# EasyEDA Pro project ProProject_IMUSensorNodes202312.epro, board 6_6_拼板20240123（带编号） (continued)
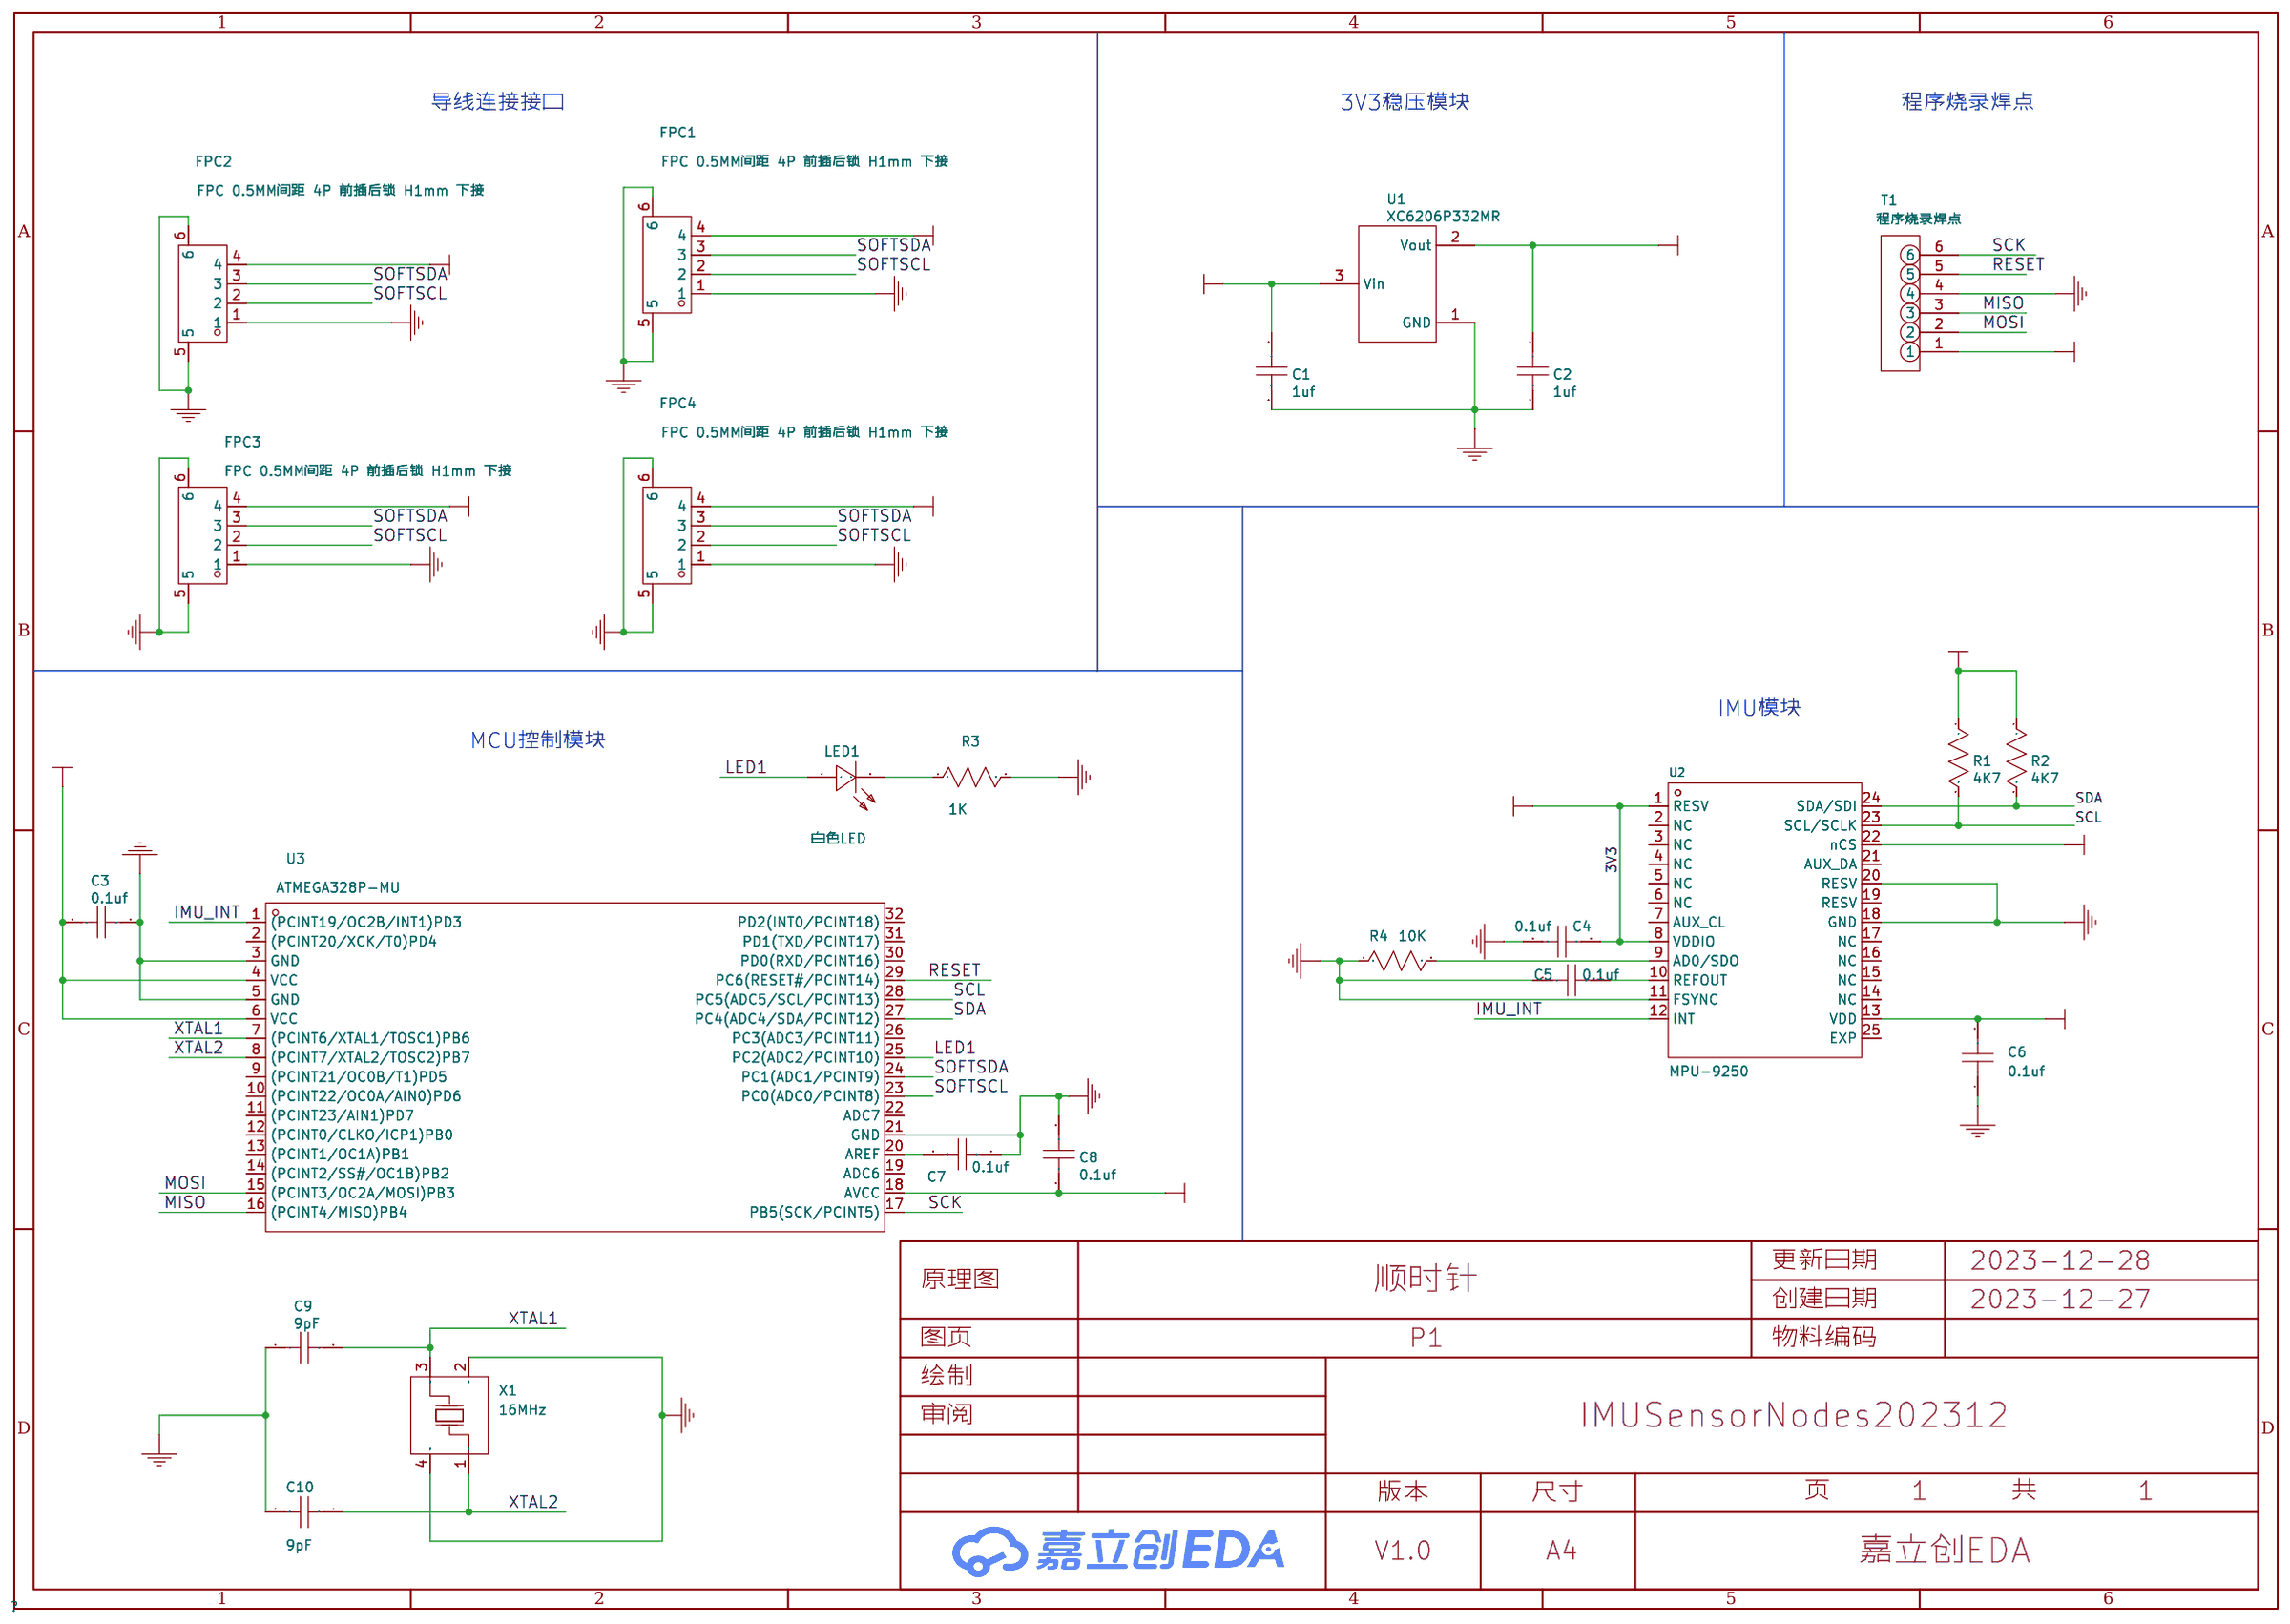
[diagram p0: schematic sheet]
## Routing (per net, layer and track width the routed paths; a pad name or vN(x,y) marks a point on that pad's centre or on a via; arc(x,y) is an arc through that point) (continued)
  Bottom Layer w0.15: Designator#773.2 49.46,52.23 50.45,52.23 50.98,51.7 v1(50.98,51.57) ; Designator#604.2 49.46,11.08 50.45,11.08 50.98,10.55 v1(50.98,10.42) ; v1(78.28,65.28) 78.28,65.42 77.75,65.94 76.76,65.94 Designator#733.2 ; v1(50.98,24.13) 50.98,24.27 50.45,24.79 49.46,24.79 Designator#551.2 ; Designator#510.2 76.76,79.66 77.75,79.66 78.28,79.13 v1(78.28,79) ; Designator#793.2 76.76,52.23 77.75,52.23 78.28,51.7 v1(78.28,51.57) ; v1(23.67,10.42) 23.67,10.55 23.15,11.08 22.15,11.08 Designator#584.2 ; v1(50.98,79) 50.98,79.13 50.45,79.66 49.46,79.66 Designator#673.2 ; Designator#651.2 22.15,79.66 23.15,79.66 23.67,79.13 v1(23.67,79) ; Designator#713.2 49.46,65.94 50.45,65.94 50.98,65.42 v1(50.98,65.28) ; v1(50.98,37.85) 50.98,37.98 50.45,38.51 49.46,38.51 Designator#480.2 ; Designator#693.2 22.15,65.94 23.15,65.94 23.67,65.42 v1(23.67,65.28) ; v1(78.28,37.85) 78.28,37.98 77.75,38.51 76.76,38.51 Designator#500.2 ; v1(23.67,51.57) 23.67,51.7 23.15,52.23 22.15,52.23 Designator#753.2 ; Designator#624.2 76.76,11.08 77.75,11.08 78.28,10.55 v1(78.28,10.42) ; Designator#530.2 22.15,24.79 23.15,24.79 23.67,24.27 v1(23.67,24.13) ; v1(78.28,24.13) 78.28,24.27 77.75,24.79 76.76,24.79 Designator#445.2 ; v1(23.67,37.85) 23.67,37.98 23.15,38.51 22.15,38.51 Designator#460.2
  Bottom Layer w0.152: Designator#896.5 59.21,61.75 58.6,62.36 58.48,62.36 58.45,62.39 58.36,62.39 58.21,62.53 Designator#819.18 ; Designator#888.18 3.6,48.82 3.75,48.67 3.84,48.67 3.87,48.64 3.99,48.64 4.6,48.03 Designator#803.5 ; Designator#917.5 4.6,6.89 3.99,7.5 3.87,7.5 3.84,7.52 3.75,7.52 3.6,7.67 Designator#438.18 ; Designator#901.18 30.91,76.25 31.06,76.1 31.15,76.1 31.17,76.08 31.29,76.08 31.9,75.47 Designator#313.5 ; Designator#319.18 30.91,48.82 31.06,48.67 31.15,48.67 31.17,48.64 31.29,48.64 31.9,48.03 Designator#916.5 ; Designator#877.18 58.21,48.82 58.36,48.67 58.45,48.67 58.48,48.64 58.6,48.64 59.21,48.03 Designator#920.5 ; Designator#806.5 31.9,6.89 31.29,7.5 31.17,7.5 31.15,7.52 31.06,7.52 30.91,7.67 Designator#831.18 ; Designator#832.5 59.21,6.89 58.6,7.5 58.48,7.5 58.45,7.52 58.36,7.52 58.21,7.67 Designator#911.18 ; Designator#437.18 3.6,76.25 3.75,76.1 3.84,76.1 3.87,76.08 3.99,76.08 4.6,75.47 Designator#325.5 ; Designator#903.5 59.21,75.47 58.6,76.08 58.48,76.08 58.45,76.1 58.36,76.1 58.21,76.25 Designator#814.18 ; Designator#317.18 3.6,35.1 3.75,34.95 3.84,34.95 3.87,34.93 3.99,34.93 4.6,34.32 Designator#440.5 ; Designator#321.5 31.9,20.6 31.29,21.21 31.17,21.21 31.15,21.24 31.06,21.24 30.91,21.39 Designator#909.18 ; Designator#811.5 4.6,61.75 3.99,62.36 3.87,62.36 3.84,62.39 3.75,62.39 3.6,62.53 Designator#818.18 ; Designator#829.5 59.21,20.6 58.6,21.21 58.48,21.21 58.45,21.24 58.36,21.24 58.21,21.39 Designator#900.18 ; Designator#878.18 30.91,62.53 31.06,62.39 31.15,62.39 31.17,62.36 31.29,62.36 31.9,61.75 Designator#808.5 ; Designator#892.5 59.21,34.32 58.6,34.93 58.48,34.93 58.45,34.95 58.36,34.95 58.21,35.1 Designator#919.18 ; Designator#827.5 31.9,34.32 31.29,34.93 31.17,34.93 31.15,34.95 31.06,34.95 30.91,35.1 Designator#921.18 ; Designator#318.18 3.6,21.39 3.75,21.24 3.84,21.24 3.87,21.21 3.99,21.21 4.6,20.6 Designator#837.5
  Bottom Layer w0.2: Designator#314.18 44.62,63.16 45.62,64.16 Designator#314.25 46.22,63.69 Designator#314.11 47.84,63.69 v1(48.04,63.5) 48.57,64.03 Designator#714.1 Designator#408.1 ; Designator#878.11 33.37,63.66 34.73,63.66 34.98,63.91 Designator#704.1 Designator#405.1 ; 17.32,62.86 17.32,63.16 18.32,64.16 Designator#915.25 18.92,63.69 Designator#915.11 20.54,63.69 v1(20.73,63.5) 21.27,64.03 Designator#694.1 Designator#402.1 ; Designator#819.11 60.68,63.66 62.04,63.66 62.29,63.91 Designator#724.1 Designator#411.1 ; Designator#435.1 Designator#451.1 7.68,36.47 7.43,36.22 6.07,36.22 Designator#317.11 ; Designator#396.1 Designator#674.1 48.57,77.74 v1(48.04,77.21) 47.84,77.41 46.22,77.41 Designator#880.25 45.62,77.88 44.62,76.88 Designator#880.18 ; Designator#921.11 33.37,36.22 34.73,36.22 34.98,36.47 Designator#471.1 Designator#334.1 ; Designator#906.21 v1(72.42,43.53) 72.42,44.86 Designator#906.33 ; Designator#378.1 Designator#615.1 62.29,9.04 62.04,8.79 60.68,8.79 Designator#911.11 ; Designator#897.18 44.62,49.45 45.62,50.45 Designator#897.25 46.22,49.97 47.84,49.97 v1(48.04,49.78) 48.57,50.31 Designator#774.1 Designator#426.1 ; 6.03,77.41 6.07,77.37 7.43,77.37 7.68,77.62 Designator#635.1 Designator#384.1 ; Designator#882.18 44.62,35.73 45.62,36.73 Designator#882.25 46.22,36.26 Designator#882.11 47.84,36.26 v1(48.04,36.06) 48.57,36.59 Designator#481.1 Designator#337.1 ; Designator#432.1 Designator#794.1 75.88,50.31 v1(75.34,49.78) 75.15,49.97 73.53,49.97 Designator#912.25 72.93,50.45 71.93,49.45 Designator#912.18 ; Designator#328.1 Designator#446.1 75.88,22.88 v1(75.34,22.35) 75.15,22.54 Designator#883.11 73.53,22.54 Designator#883.25 72.93,23.02 71.93,22.02 Designator#883.18 ; Designator#909.11 33.37,22.51 34.73,22.51 34.98,22.76 Designator#541.1 Designator#355.1 ; 17.32,21.72 17.32,22.02 18.32,23.02 Designator#836.25 18.92,22.54 Designator#836.11 20.54,22.54 v1(20.73,22.35) 21.27,22.88 Designator#531.1 Designator#352.1 ; Designator#331.1 Designator#461.1 21.27,36.59 v1(20.73,36.06) 20.54,36.26 Designator#923.11 18.92,36.26 Designator#923.25 18.32,36.73 17.32,35.73 17.32,35.43 ; Designator#889.33 45.12,72.3 v1(45.12,70.96) Designator#889.21 ; Designator#818.11 6.07,63.66 7.43,63.66 7.68,63.91 Designator#684.1 Designator#399.1 ; Designator#318.11 6.07,22.51 7.43,22.51 7.68,22.76 Designator#521.1 Designator#349.1 ; Designator#820.21 v1(17.81,70.96) 17.81,72.3 Designator#820.33 ; Designator#839.21 v1(45.12,29.81) 45.12,31.15 Designator#839.33 ; Designator#372.1 Designator#595.1 34.98,9.04 34.73,8.79 33.37,8.79 Designator#831.11 ; Designator#895.33 72.42,17.43 v1(72.42,16.1) Designator#895.21 ; 17.32,76.58 17.32,76.88 18.32,77.88 Designator#886.25 18.92,77.41 20.54,77.41 v1(20.73,77.21) 21.27,77.74 Designator#652.1 Designator#390.1 ; Designator#801.33 72.42,31.15 v1(72.42,29.81) Designator#801.21 ; 6.03,49.97 6.07,49.94 7.43,49.94 7.68,50.19 Designator#744.1 Designator#417.1 ; Designator#913.33 17.81,3.72 v1(17.81,2.38) Designator#913.21 ; Designator#904.21 v1(17.81,16.1) 17.81,17.43 Designator#904.33 ; 33.34,77.41 33.37,77.37 34.73,77.37 34.98,77.62 Designator#664.1 Designator#393.1 ; 33.34,49.97 33.37,49.94 34.73,49.94 34.98,50.19 Designator#764.1 Designator#423.1 ; Designator#322.33 45.12,44.86 v1(45.12,43.53) Designator#322.21 ; Designator#810.33 72.42,72.3 v1(72.42,70.96) Designator#810.21 ; Designator#813.18 44.62,22.02 45.62,23.02 Designator#813.25 46.22,22.54 Designator#813.11 47.84,22.54 v1(48.04,22.35) 48.57,22.88 Designator#552.1 Designator#358.1 ; Designator#340.1 Designator#491.1 62.29,36.47 62.04,36.22 60.68,36.22 Designator#919.11 ; Designator#809.33 72.42,58.58 v1(72.42,57.25) Designator#809.21 ; Designator#346.1 Designator#511.1 75.88,77.74 v1(75.34,77.21) 75.15,77.41 73.53,77.41 Designator#918.25 72.93,77.88 71.93,76.88 Designator#918.18 ; Designator#324.33 45.12,58.58 v1(45.12,57.25) Designator#324.21 ; Designator#429.1 Designator#784.1 62.29,50.19 62.04,49.94 60.68,49.94 60.64,49.97 ; Designator#438.11 6.07,8.79 7.43,8.79 7.68,9.04 Designator#575.1 Designator#366.1 ; Designator#902.33 17.81,44.86 v1(17.81,43.53) Designator#902.21 ; Designator#361.1 Designator#560.1 62.29,22.76 62.04,22.51 60.68,22.51 Designator#900.11 ; Designator#375.1 Designator#605.1 48.57,9.16 v1(48.04,8.63) 47.84,8.83 Designator#326.11 46.22,8.83 Designator#326.25 45.62,9.3 44.62,8.3 Designator#326.18 ; 17.32,49.15 17.32,49.45 18.32,50.45 Designator#890.25 18.92,49.97 20.54,49.97 v1(20.73,49.78) 21.27,50.31 Designator#754.1 Designator#420.1 ; Designator#835.33 17.81,58.58 v1(17.81,57.25) Designator#835.21 ; Designator#343.1 Designator#501.1 75.88,36.59 v1(75.34,36.06) 75.15,36.26 Designator#830.11 73.53,36.26 Designator#830.25 72.93,36.73 71.93,35.73 Designator#830.18 ; Designator#826.18 71.93,8.3 72.93,9.3 Designator#826.25 73.53,8.83 Designator#826.11 75.15,8.83 v1(75.34,8.63) 75.88,9.16 Designator#625.1 Designator#381.1 ; Designator#369.1 Designator#585.1 21.27,9.16 v1(20.73,8.63) 20.54,8.83 Designator#323.11 18.92,8.83 Designator#323.25 18.32,9.3 17.32,8.3 17.32,8 ; Designator#881.18 71.93,63.16 72.93,64.16 Designator#881.25 73.53,63.69 Designator#881.11 75.15,63.69 v1(75.34,63.5) 75.88,64.03 Designator#734.1 Designator#414.1 ; Designator#838.33 45.12,3.72 v1(45.12,2.38) Designator#838.21 ; Designator#822.21 v1(17.81,29.81) 17.81,31.15 Designator#822.33 ; Designator#910.33 72.42,3.72 v1(72.42,2.38) Designator#910.21 ; Designator#387.1 Designator#654.1 62.29,77.62 62.04,77.37 60.68,77.37 60.64,77.41 ; Designator#885.21 v1(45.12,16.1) 45.12,17.43 Designator#885.33
  Bottom Layer w0.254: v1(69.9,21.71) 70.01,21.71 70.24,21.49 70.24,20.98 ; Designator#476.2 48.52,31.7 v1(49.28,32.46) 49,32.46 48.52,32.95 Designator#474.2 ; Designator#600.2 48.52,4.27 v1(49.28,5.03) 49,5.03 48.52,5.52 Designator#598.2 ; Designator#525.1 17.81,14.54 Designator#904.21 ; 64.19,79.28 64.42,79.28 64.57,79.13 v2(64.57,79.02) 64.57,78.13 64.45,78.01 ; 36.88,24.41 37.12,24.41 37.27,24.26 v2(37.27,24.16) 37.27,23.27 37.14,23.14 ; Designator#549.2 50.98,23.26 v1(50.98,24.13) 50.7,24.41 Designator#550.1 ; Designator#580.2 21.21,4.27 v1(21.98,5.03) 21.7,5.03 21.21,5.52 Designator#578.2 ; Designator#822.3 17.31,32.02 v1(17.43,31.91) 17.94,31.4 Designator#822.33 18.31,31.65 Designator#822.5 ; Designator#641.2 56.42,76.84 v1(56.42,77.25) ; Designator#618.2 75.82,5.52 76.31,5.03 v1(76.59,5.03) 75.82,4.27 Designator#620.2 ; 37.14,78.01 37.27,78.13 v2(37.27,79.02) 37.27,79.13 37.12,79.28 36.88,79.28 ; Designator#691.2 23.67,64.41 v1(23.67,65.28) 23.39,65.56 Designator#692.1 ; 64.19,65.56 64.42,65.56 64.57,65.41 v2(64.57,65.31) 64.57,64.42 64.45,64.29 ; Designator#528.2 23.67,23.26 v1(23.67,24.13) 23.39,24.41 Designator#529.1 ; v1(55.53,1.55) 55.15,1.93 55.15,2.44 55.53,2.82 57.82,2.82 Designator#832.33 ; 15.63,34.7 15.63,35.21 15.4,35.43 v1(15.29,35.43) ; Designator#917.33 3.21,2.82 0.92,2.82 0.54,2.44 0.54,1.93 v1(0.92,1.55) ; Designator#324.21 45.12,55.68 Designator#708.1 ; 37.14,9.43 37.27,9.55 v2(37.27,10.44) 37.27,10.55 37.12,10.7 36.88,10.7 ; Designator#314.20 45.02,63.69 arc(45.1,63.7) 45.17,63.71 arc(45.45,63.87) 45.61,64.15 arc(45.62,64.22) Designator#314.25 ; v1(28.22,1.55) 27.84,1.93 27.84,2.44 28.22,2.82 30.51,2.82 Designator#806.33 ; Designator#499.1 78,38.13 v1(78.28,37.85) 78.28,36.98 Designator#498.2 ; Designator#829.33 57.82,16.54 55.53,16.54 55.15,16.16 55.15,15.65 v1(55.53,15.27) ; v1(79.66,19.21) Designator#562.2 ; v1(29.11,63.53) 29.11,63.12 Designator#700.2 ; 64.19,38.13 64.42,38.13 64.57,37.98 v2(64.57,37.88) 64.57,36.98 64.45,36.86 ; Designator#603.1 50.7,10.7 v1(50.98,10.42) 50.98,9.55 Designator#602.2 ; Designator#727.2 75.82,60.38 76.31,59.89 v1(76.59,59.89) 75.82,59.13 Designator#729.2 ; v1(29.11,8.66) 29.11,8.26 Designator#591.2 ; v1(42.6,35.43) 42.71,35.43 42.93,35.21 42.93,34.7 ; Designator#882.20 45.02,36.26 arc(45.1,36.26) 45.17,36.28 arc(45.45,36.44) 45.61,36.71 arc(45.62,36.79) Designator#882.25 ; 9.84,64.29 9.96,64.42 v2(9.96,65.31) 9.96,65.41 9.81,65.56 9.58,65.56 ; v1(29.11,22.38) 29.11,21.97 Designator#537.2 ; v1(1.81,8.66) 1.81,8.26 Designator#571.2 ; Designator#650.1 23.39,79.28 v1(23.67,79) 23.67,78.13 Designator#649.2 ; Designator#324.5 45.62,59.08 Designator#324.33 45.24,58.83 v1(44.73,59.34) 44.62,59.45 Designator#324.3 ; Designator#839.3 44.62,32.02 v1(44.73,31.91) 45.24,31.4 Designator#839.33 45.62,31.65 Designator#839.5 ; 42.93,7.27 42.93,7.78 42.71,8 v1(42.6,8) ; Designator#902.21 17.81,41.97 Designator#748.1 ; v1(15.29,8) 15.4,8 15.63,7.78 15.63,7.27 ; v1(56.42,8.66) 56.42,8.26 Designator#611.2 ; Designator#889.5 45.62,72.8 Designator#889.33 45.24,72.55 v1(44.73,73.05) 44.62,73.17 Designator#889.3 ; Designator#517.2 1.81,21.97 v1(1.81,22.38) ; 64.45,50.58 64.57,50.7 v2(64.57,51.59) 64.57,51.69 64.42,51.84 64.19,51.84 ; Designator#544.2 48.52,19.23 49,18.75 v1(49.28,18.75) 48.52,17.98 Designator#546.2 ; v1(55.53,56.42) 55.15,56.8 55.15,57.31 55.53,57.69 57.82,57.69 Designator#896.33 ; Designator#769.2 48.52,45.41 v1(49.28,46.18) 49,46.18 48.52,46.66 Designator#767.2 ; Designator#885.21 45.12,14.54 Designator#545.1 ; Designator#895.21 72.42,14.54 Designator#564.1 ; Designator#904.5 18.31,17.93 Designator#904.33 17.94,17.68 v1(17.43,18.19) 17.31,18.31 Designator#904.3 ; Designator#313.33 30.51,71.4 28.22,71.4 27.84,71.02 27.84,70.51 v1(28.22,70.13) ; v1(56.42,63.53) 56.42,63.12 Designator#720.2 ; v1(69.9,62.86) 70.01,62.86 70.24,62.64 70.24,62.13 ; 42.93,75.85 42.93,76.36 42.71,76.58 v1(42.6,76.58) ; Designator#913.5 18.31,4.22 Designator#913.33 17.94,3.97 v1(17.43,4.47) 17.31,4.59 Designator#913.3 ; 15.63,20.98 15.63,21.49 15.4,21.71 v1(15.29,21.71) ; 37.14,36.86 37.27,36.98 v2(37.27,37.88) 37.27,37.98 37.12,38.13 36.88,38.13 ; v1(79.66,46.64) Designator#786.2 ; Designator#731.2 78.28,64.41 v1(78.28,65.28) 78,65.56 Designator#732.1 ; v1(42.6,49.15) 42.71,49.15 42.93,48.92 42.93,48.42 ; 9.58,79.28 9.81,79.28 9.96,79.13 v2(9.96,79.02) 9.96,78.13 9.84,78.01 ; Designator#444.1 78,24.41 v1(78.28,24.13) 78.28,23.26 Designator#443.2 ; Designator#810.21 72.42,69.4 Designator#505.1 ; v1(52.35,5.49) Designator#597.2 ; Designator#820.5 18.31,72.8 Designator#820.33 17.94,72.55 v1(17.43,73.05) 17.31,73.17 Designator#820.3 ; Designator#889.21 45.12,69.4 Designator#668.1 ; Designator#801.21 72.42,28.25 Designator#495.1 ; Designator#711.2 50.98,64.41 v1(50.98,65.28) 50.7,65.56 Designator#712.1 ; Designator#813.20 45.02,22.54 arc(45.1,22.55) 45.17,22.56 arc(45.45,22.72) 45.61,23 arc(45.62,23.07) Designator#813.25 ; Designator#809.5 72.92,59.08 Designator#809.33 72.55,58.83 v1(72.04,59.34) 71.92,59.45 Designator#809.3 ; Designator#810.5 72.92,72.8 Designator#810.33 72.55,72.55 v1(72.04,73.05) 71.92,73.17 Designator#810.3 ; Designator#809.21 72.42,55.68 Designator#728.1 ; 36.88,65.56 37.12,65.56 37.27,65.41 v2(37.27,65.31) 37.27,64.42 37.14,64.29 ; Designator#791.2 78.28,50.7 v1(78.28,51.57) 78,51.84 Designator#792.1 ; Designator#895.5 72.92,17.93 Designator#895.33 72.55,17.68 v1(72.04,18.19) 71.92,18.31 Designator#895.3 ; Designator#526.2 21.21,17.98 v1(21.98,18.75) 21.7,18.75 21.21,19.23 Designator#524.2 ; Designator#910.21 72.42,0.82 Designator#619.1 ; Designator#660.2 29.11,76.84 v1(29.11,77.25) ; v1(28.22,15.27) 27.84,15.65 27.84,16.16 28.22,16.54 30.51,16.54 Designator#321.33 ; 15.63,48.42 15.63,48.92 15.4,49.15 v1(15.29,49.15) ; Designator#454.2 21.21,32.95 21.7,32.46 v1(21.98,32.46) 21.21,31.7 Designator#456.2 ; Designator#789.2 75.82,45.41 v1(76.59,46.18) 76.31,46.18 75.82,46.66 Designator#787.2 ; v1(79.66,60.35) Designator#726.2 ; 71.5,49.97 72.33,49.97 arc(72.4,49.98) 72.47,49.99 arc(72.75,50.15) 72.91,50.43 arc(72.92,50.5) Designator#912.25 ; v1(79.66,32.92) Designator#493.2 ; Designator#838.3 44.62,4.59 v1(44.73,4.47) 45.24,3.97 Designator#838.33 45.62,4.22 Designator#838.5 ; Designator#910.5 72.92,4.22 Designator#910.33 72.55,3.97 v1(72.04,4.47) 71.92,4.59 Designator#910.3 ; v1(28.22,42.7) 27.84,43.08 27.84,43.59 28.22,43.97 30.51,43.97 Designator#916.33 ; 9.84,50.58 9.96,50.7 v2(9.96,51.59) 9.96,51.69 9.81,51.84 9.58,51.84 ; 70.24,7.27 70.24,7.78 70.01,8 v1(69.9,8) ; Designator#883.20 72.33,22.54 arc(72.4,22.55) 72.47,22.56 arc(72.75,22.72) 72.91,23 arc(72.92,23.07) Designator#883.25 ; Designator#487.2 56.42,35.69 v1(56.42,36.1) ; Designator#751.2 23.67,50.7 v1(23.67,51.57) 23.39,51.84 Designator#752.1 ; Designator#583.1 23.39,10.7 v1(23.67,10.42) 23.67,9.55 Designator#582.2 ; Designator#459.1 23.39,38.13 v1(23.67,37.85) 23.67,36.98 Designator#458.2 ; Designator#801.5 72.92,31.65 Designator#801.33 72.55,31.4 v1(72.04,31.91) 71.92,32.02 Designator#801.3 ; Designator#455.1 17.81,28.25 Designator#822.21 ; 16.89,77.41 17.72,77.41 arc(17.79,77.41) 17.86,77.42 arc(18.14,77.58) 18.3,77.86 arc(18.31,77.93) Designator#886.25 ; v1(25.05,19.21) Designator#523.2 ; Designator#467.2 29.11,35.69 v1(29.11,36.1) ; Designator#885.5 45.62,17.93 Designator#885.33 45.24,17.68 v1(44.73,18.19) 44.62,18.31 Designator#885.3 ; Designator#803.33 3.21,43.97 0.92,43.97 0.54,43.59 0.54,43.08 v1(0.92,42.7) ; Designator#631.2 1.81,76.84 v1(1.81,77.25) ; Designator#800.2 1.81,35.69 v1(1.81,36.1) ; Designator#563.2 75.82,19.23 76.31,18.75 v1(76.59,18.75) 75.82,17.98 Designator#565.2 ; 16.89,49.97 17.72,49.97 arc(17.79,49.98) 17.86,49.99 arc(18.14,50.15) 18.3,50.43 arc(18.31,50.5) Designator#890.25 ; Designator#827.33 30.51,30.25 28.22,30.25 27.84,29.87 27.84,29.37 v1(28.22,28.98) ; v1(0.92,15.27) 0.54,15.65 0.54,16.16 0.92,16.54 3.21,16.54 Designator#837.33 ; Designator#835.5 18.31,59.08 Designator#835.33 17.94,58.83 v1(17.43,59.34) 17.31,59.45 Designator#835.3 ; v1(29.11,49.81) 29.11,49.41 Designator#760.2 ; v1(28.22,56.42) 27.84,56.8 27.84,57.31 28.22,57.69 30.51,57.69 Designator#808.33 ; v1(0.92,70.13) 0.54,70.51 0.54,71.02 0.92,71.4 3.21,71.4 Designator#325.33 ; Designator#646.2 21.21,72.85 v1(21.98,73.61) 21.7,73.61 21.21,74.1 Designator#644.2 ; Designator#645.1 17.81,69.4 Designator#820.21 ; 37.14,50.58 37.27,50.7 v2(37.27,51.59) 37.27,51.69 37.12,51.84 36.88,51.84 ; Designator#504.2 75.82,74.1 76.31,73.61 v1(76.59,73.61) 75.82,72.85 Designator#506.2 ; Designator#811.33 3.21,57.69 0.92,57.69 0.54,57.31 0.54,56.8 v1(0.92,56.42) ; v1(25.05,74.07) Designator#643.2 ; v1(42.6,62.86) 42.71,62.86 42.93,62.64 42.93,62.13 ; Designator#839.21 45.12,28.25 Designator#475.1 ; Designator#826.20 72.33,8.83 arc(72.4,8.83) 72.47,8.84 arc(72.75,9) 72.91,9.28 arc(72.92,9.35) Designator#826.25 ; v1(1.81,63.53) 1.81,63.12 Designator#680.2 ; 71.5,77.41 72.33,77.41 arc(72.4,77.41) 72.47,77.42 arc(72.75,77.58) 72.91,77.86 arc(72.92,77.93) Designator#918.25 ; Designator#906.21 72.42,41.97 Designator#788.1 ; v1(52.35,60.35) Designator#706.2 ; Designator#902.5 18.31,45.36 Designator#902.33 17.94,45.11 v1(17.43,45.62) 17.31,45.74 Designator#902.3 ; Designator#508.2 78.28,78.13 v1(78.28,79) 78,79.28 Designator#509.1 ; v1(52.35,19.21) Designator#543.2 ; Designator#915.20 17.72,63.69 arc(17.79,63.7) 17.86,63.71 arc(18.14,63.87) 18.3,64.15 arc(18.31,64.22) Designator#915.25 ; Designator#689.2 21.21,59.13 v1(21.98,59.89) 21.7,59.89 21.21,60.38 Designator#687.2 ; v1(42.6,21.71) 42.71,21.71 42.93,21.49 42.93,20.98 ; Designator#494.2 75.82,32.95 76.31,32.46 v1(76.59,32.46) 75.82,31.7 Designator#496.2 ; Designator#906.3 71.92,45.74 v1(72.04,45.62) 72.55,45.11 Designator#906.33 72.92,45.36 Designator#906.5 ; Designator#671.2 50.98,78.13 v1(50.98,79) 50.7,79.28 Designator#672.1 ; Designator#667.2 48.52,74.1 49,73.61 v1(49.28,73.61) 48.52,72.85 Designator#669.2 ; v1(69.9,76.58) 70.01,76.58 70.24,76.36 70.24,75.85 ; 9.84,36.86 9.96,36.98 v2(9.96,37.88) 9.96,37.98 9.81,38.13 9.58,38.13 ; v1(52.35,46.64) Designator#766.2 ; Designator#599.1 45.12,0.82 Designator#838.21 ; Designator#707.2 48.52,60.38 49,59.89 v1(49.28,59.89) 48.52,59.13 Designator#709.2 ; Designator#622.2 78.28,9.55 v1(78.28,10.42) 78,10.7 Designator#623.1 ; 44.2,77.41 45.02,77.41 arc(45.1,77.41) 45.17,77.42 arc(45.45,77.58) 45.61,77.86 arc(45.62,77.93) Designator#880.25 ; 64.45,23.14 64.57,23.27 v2(64.57,24.16) 64.57,24.26 64.42,24.41 64.19,24.41 ; Designator#747.2 21.21,46.66 21.7,46.18 v1(21.98,46.18) 21.21,45.41 Designator#749.2 ; 9.84,9.43 9.96,9.55 v2(9.96,10.44) 9.96,10.55 9.81,10.7 9.58,10.7 ; v1(79.66,5.49) Designator#617.2 ; Designator#323.20 17.72,8.83 arc(17.79,8.83) 17.86,8.84 arc(18.14,9) 18.3,9.28 arc(18.31,9.35) Designator#323.25 ; Designator#740.2 1.81,49.41 v1(1.81,49.81) ; v1(55.53,42.7) 55.15,43.08 55.15,43.59 55.53,43.97 57.82,43.97 Designator#920.33 ; Designator#772.1 50.7,51.84 v1(50.98,51.57) 50.98,50.7 Designator#771.2 ; Designator#440.33 3.21,30.25 0.92,30.25 0.54,29.87 0.54,29.37 v1(0.92,28.98) ; v1(25.05,46.64) Designator#746.2 ; Designator#780.2 56.42,49.41 v1(56.42,49.81) ; Designator#322.21 45.12,41.97 Designator#768.1 ; 15.63,75.85 15.63,76.36 15.4,76.58 v1(15.29,76.58) ; v1(69.9,35.43) 70.01,35.43 70.24,35.21 70.24,34.7 ; v1(69.9,49.15) 70.01,49.15 70.24,48.92 70.24,48.42 ; 44.2,49.97 45.02,49.97 arc(45.1,49.98) 45.17,49.99 arc(45.45,50.15) 45.61,50.43 arc(45.62,50.5) Designator#897.25 ; Designator#322.5 45.62,45.36 Designator#322.33 45.24,45.11 v1(44.73,45.62) 44.62,45.74 Designator#322.3 ; v1(25.05,5.49) Designator#577.2 ; 64.19,10.7 64.42,10.7 64.57,10.55 v2(64.57,10.44) 64.57,9.55 64.45,9.43 ; Designator#688.1 17.81,55.68 Designator#835.21 ; v1(25.05,60.35) Designator#686.2 ; Designator#836.20 17.72,22.54 arc(17.79,22.55) 17.86,22.56 arc(18.14,22.72) 18.3,23 arc(18.31,23.07) Designator#836.25 ; Designator#881.20 72.33,63.69 arc(72.4,63.7) 72.47,63.71 arc(72.75,63.87) 72.91,64.15 arc(72.92,64.22) Designator#881.25 ; Designator#923.20 17.72,36.26 arc(17.79,36.26) 17.86,36.28 arc(18.14,36.44) 18.3,36.71 arc(18.31,36.79) Designator#923.25 ; 9.84,23.14 9.96,23.27 v2(9.96,24.16) 9.96,24.26 9.81,24.41 9.58,24.41 ; 15.63,62.13 15.63,62.64 15.4,62.86 v1(15.29,62.86) ; v1(52.35,74.07) Designator#666.2 ; Designator#479.1 50.7,38.13 v1(50.98,37.85) 50.98,36.98 Designator#478.2 ; v1(52.35,32.92) Designator#473.2 ; v1(25.05,32.92) Designator#453.2 ; v1(79.66,74.07) Designator#503.2 ; v1(56.42,22.38) 56.42,21.97 Designator#558.2 ; Designator#830.20 72.33,36.26 arc(72.4,36.26) 72.47,36.28 arc(72.75,36.44) 72.91,36.71 arc(72.92,36.79) Designator#830.25 ; Designator#326.20 45.02,8.83 arc(45.1,8.83) 45.17,8.84 arc(45.45,9) 45.61,9.28 arc(45.62,9.35) Designator#326.25 ; v1(55.53,28.98) 55.15,29.37 55.15,29.87 55.53,30.25 57.82,30.25 Designator#892.33 ; v1(55.53,70.13) 55.15,70.51 55.15,71.02 55.53,71.4 57.82,71.4 Designator#903.33 ; Designator#913.21 17.81,0.82 Designator#579.1
  vias: v1(3.2,73.01) v1(3.21,71.78) v1(3.2,59.3) v1(3.21,58.07) v1(3.2,45.58) v1(3.21,44.35) v1(3.2,31.87) v1(3.21,30.64) v1(3.2,18.15) v1(3.21,16.92) v1(3.2,4.43) v1(3.21,3.2) v1(4.13,78.15) v1(4.13,77.5) v1(4.13,64.44) v1(4.13,63.79) v1(4.13,50.72) v1(4.13,50.07) v1(4.13,37) v1(4.13,36.36) v1(4.13,23.29) v1(4.13,22.64) v1(4.13,9.57) v1(4.13,8.93) v1(4.35,73.01) v1(4.33,71.78) v1(4.35,59.3) v1(4.33,58.06) v1(4.35,45.58) v1(4.33,44.35) v1(4.35,31.87) v1(4.33,30.63) v1(4.35,18.15) v1(4.33,16.91) v1(4.35,4.43) v1(4.33,3.2) v1(5.14,78.15) v1(5.14,64.44) v1(5.14,50.72) v1(5.14,37) v1(5.14,23.29) v1(5.14,9.57) v1(10.19,69.24) v1(10.19,55.53) v1(10.19,41.81) v1(10.19,28.1) v1(10.19,14.38) v1(10.19,0.66) v1(10.7,76.1) v1(10.7,62.39) v1(10.7,48.67) v1(10.7,34.95) v1(10.7,21.24) v1(10.7,7.52) v1(11.21,77.75) v1(11.21,64.04) v1(11.21,50.32) v1(11.21,36.61) v1(11.21,22.89) v1(11.21,9.17) v1(16.67,72.22) v1(16.67,58.5) v1(16.67,44.78) v1(16.67,31.07) v1(16.67,17.35) v1(16.67,3.64) v1(17.18,76.48) v1(17.18,62.77) v1(17.18,49.05) v1(17.18,35.33) v1(17.18,21.62) v1(17.18,7.9) v1(18.7,71.28) v1(18.7,57.56) v1(18.7,43.84) v1(18.7,30.13) v1(18.7,16.41) v1(18.7,2.7) v1(24.39,72.98) v1(24.39,59.26) v1(24.39,45.54) v1(24.39,31.83) v1(24.39,18.11) v1(24.39,4.4) v1(24.92,77.82) v1(24.92,64.1) v1(24.92,50.38) v1(24.92,36.67) v1(24.92,22.95) v1(24.92,9.24) v1(30.5,73.01) v1(30.51,71.78) v1(30.5,59.3) v1(30.51,58.07) v1(30.5,45.58) v1(30.51,44.35) v1(30.5,31.87) v1(30.51,30.64) v1(30.5,18.15) v1(30.51,16.92) v1(30.5,4.43) v1(30.51,3.2) v1(31.43,78.15) v1(31.43,77.5) v1(31.43,64.44) v1(31.43,63.79) v1(31.43,50.72) v1(31.43,50.07) v1(31.43,37) v1(31.43,36.36) v1(31.43,23.29) v1(31.43,22.64) v1(31.43,9.57) v1(31.43,8.93) v1(31.64,71.78) v1(31.64,58.06) v1(31.64,44.35) v1(31.64,30.63) v1(31.64,16.91) v1(31.64,3.2) v1(31.65,73.01) v1(31.65,59.3) v1(31.65,45.58) v1(31.65,31.87) v1(31.65,18.15) v1(31.65,4.43) v1(32.45,78.15) v1(32.45,64.44) v1(32.45,50.72) v1(32.45,37) v1(32.45,23.29) v1(32.45,9.57) v1(37.5,69.24) v1(37.5,55.53) v1(37.5,41.81) v1(37.5,28.1) v1(37.5,14.38) v1(37.5,0.66) v1(38,76.1) v1(38,62.39) v1(38,48.67) v1(38,34.95) v1(38,21.24) v1(38,7.52) v1(38.51,77.75) v1(38.51,64.04) v1(38.51,50.32) v1(38.51,36.61) v1(38.51,22.89) v1(38.51,9.17) v1(43.97,72.22) v1(43.97,58.5) v1(43.97,44.78) v1(43.97,31.07) v1(43.97,17.35) v1(43.97,3.64) v1(44.48,76.48) v1(44.48,62.77) v1(44.48,49.05) v1(44.48,35.33) v1(44.48,21.62) v1(44.48,7.9) v1(46,71.28) v1(46,57.56) v1(46,43.84) v1(46,30.13) v1(46,16.41) v1(46,2.7) v1(51.69,72.98) v1(51.69,59.26) v1(51.69,45.54) v1(51.69,31.83) v1(51.69,18.11) v1(51.69,4.4) v1(52.23,77.82) v1(52.23,64.1) v1(52.23,50.38) v1(52.23,36.67) v1(52.23,22.95) v1(52.23,9.24) v1(57.81,73.01) v1(57.82,71.78) v1(57.81,59.3) v1(57.82,58.07) v1(57.81,45.58) v1(57.82,44.35) v1(57.81,31.87) v1(57.82,30.64) v1(57.81,18.15) v1(57.82,16.92) v1(57.81,4.43) v1(57.82,3.2) v1(58.74,78.15) v1(58.74,77.5) v1(58.74,64.44) v1(58.74,63.79) v1(58.74,50.72) v1(58.74,50.07) v1(58.74,37) v1(58.74,36.36) v1(58.74,23.29) v1(58.74,22.64) v1(58.74,9.57) v1(58.74,8.93) v1(58.94,71.78) v1(58.94,58.06) v1(58.94,44.35) v1(58.94,30.63) v1(58.94,16.91) v1(58.94,3.2) v1(58.96,73.01) v1(58.96,59.3) v1(58.96,45.58) v1(58.96,31.87) v1(58.96,18.15) v1(58.96,4.43) v1(59.75,78.15) v1(59.75,64.44) v1(59.75,50.72) v1(59.75,37) v1(59.75,23.29) v1(59.75,9.57) v1(64.8,69.24) v1(64.8,55.53) v1(64.8,41.81) v1(64.8,28.1) v1(64.8,14.38) v1(64.8,0.66) v1(65.31,76.1) v1(65.31,62.39) v1(65.31,48.67) v1(65.31,34.95) v1(65.31,21.24) v1(65.31,7.52) v1(65.82,77.75) v1(65.82,64.04) v1(65.82,50.32) v1(65.82,36.61) v1(65.82,22.89) v1(65.82,9.17) v1(71.28,72.22) v1(71.28,58.5) v1(71.28,44.78) v1(71.28,31.07) v1(71.28,17.35) v1(71.28,3.64) v1(71.79,76.48) v1(71.79,62.77) v1(71.79,49.05) v1(71.79,35.33) v1(71.79,21.62) v1(71.79,7.9) v1(73.31,71.28) v1(73.31,57.56) v1(73.31,43.84) v1(73.31,30.13) v1(73.31,16.41) v1(73.31,2.7) v1(79,72.98) v1(79,59.26) v1(79,45.54) v1(79,31.83) v1(79,18.11) v1(79,4.4) v1(79.53,77.82) v1(79.53,64.1) v1(79.53,50.38) v1(79.53,36.67) v1(79.53,22.95) v1(79.53,9.24) v2(9.22,78.54) v2(9.22,64.82) v2(9.22,51.11) v2(9.22,37.39) v2(9.22,23.68) v2(9.22,9.96) v2(10.67,72.98) v2(10.67,59.26) v2(10.67,45.54) v2(10.67,31.83) v2(10.67,18.11) v2(10.67,4.4) v2(36.52,78.54) v2(36.52,64.82) v2(36.52,51.11) v2(36.52,37.39) v2(36.52,23.68) v2(36.52,9.96) v2(37.98,72.98) v2(37.98,59.26) v2(37.98,45.54) v2(37.98,31.83) v2(37.98,18.11) v2(37.98,4.4) v2(63.83,78.54) v2(63.83,64.82) v2(63.83,51.11) v2(63.83,37.39) v2(63.83,23.68) v2(63.83,9.96) v2(65.28,72.98) v2(65.28,59.26) v2(65.28,45.54) v2(65.28,31.83) v2(65.28,18.11) v2(65.28,4.4)
